# EasyEDA Pro project ProProject_IMUSensorNodes202312.epro, board 6_6_拼板20240123（不带编号） (continued)
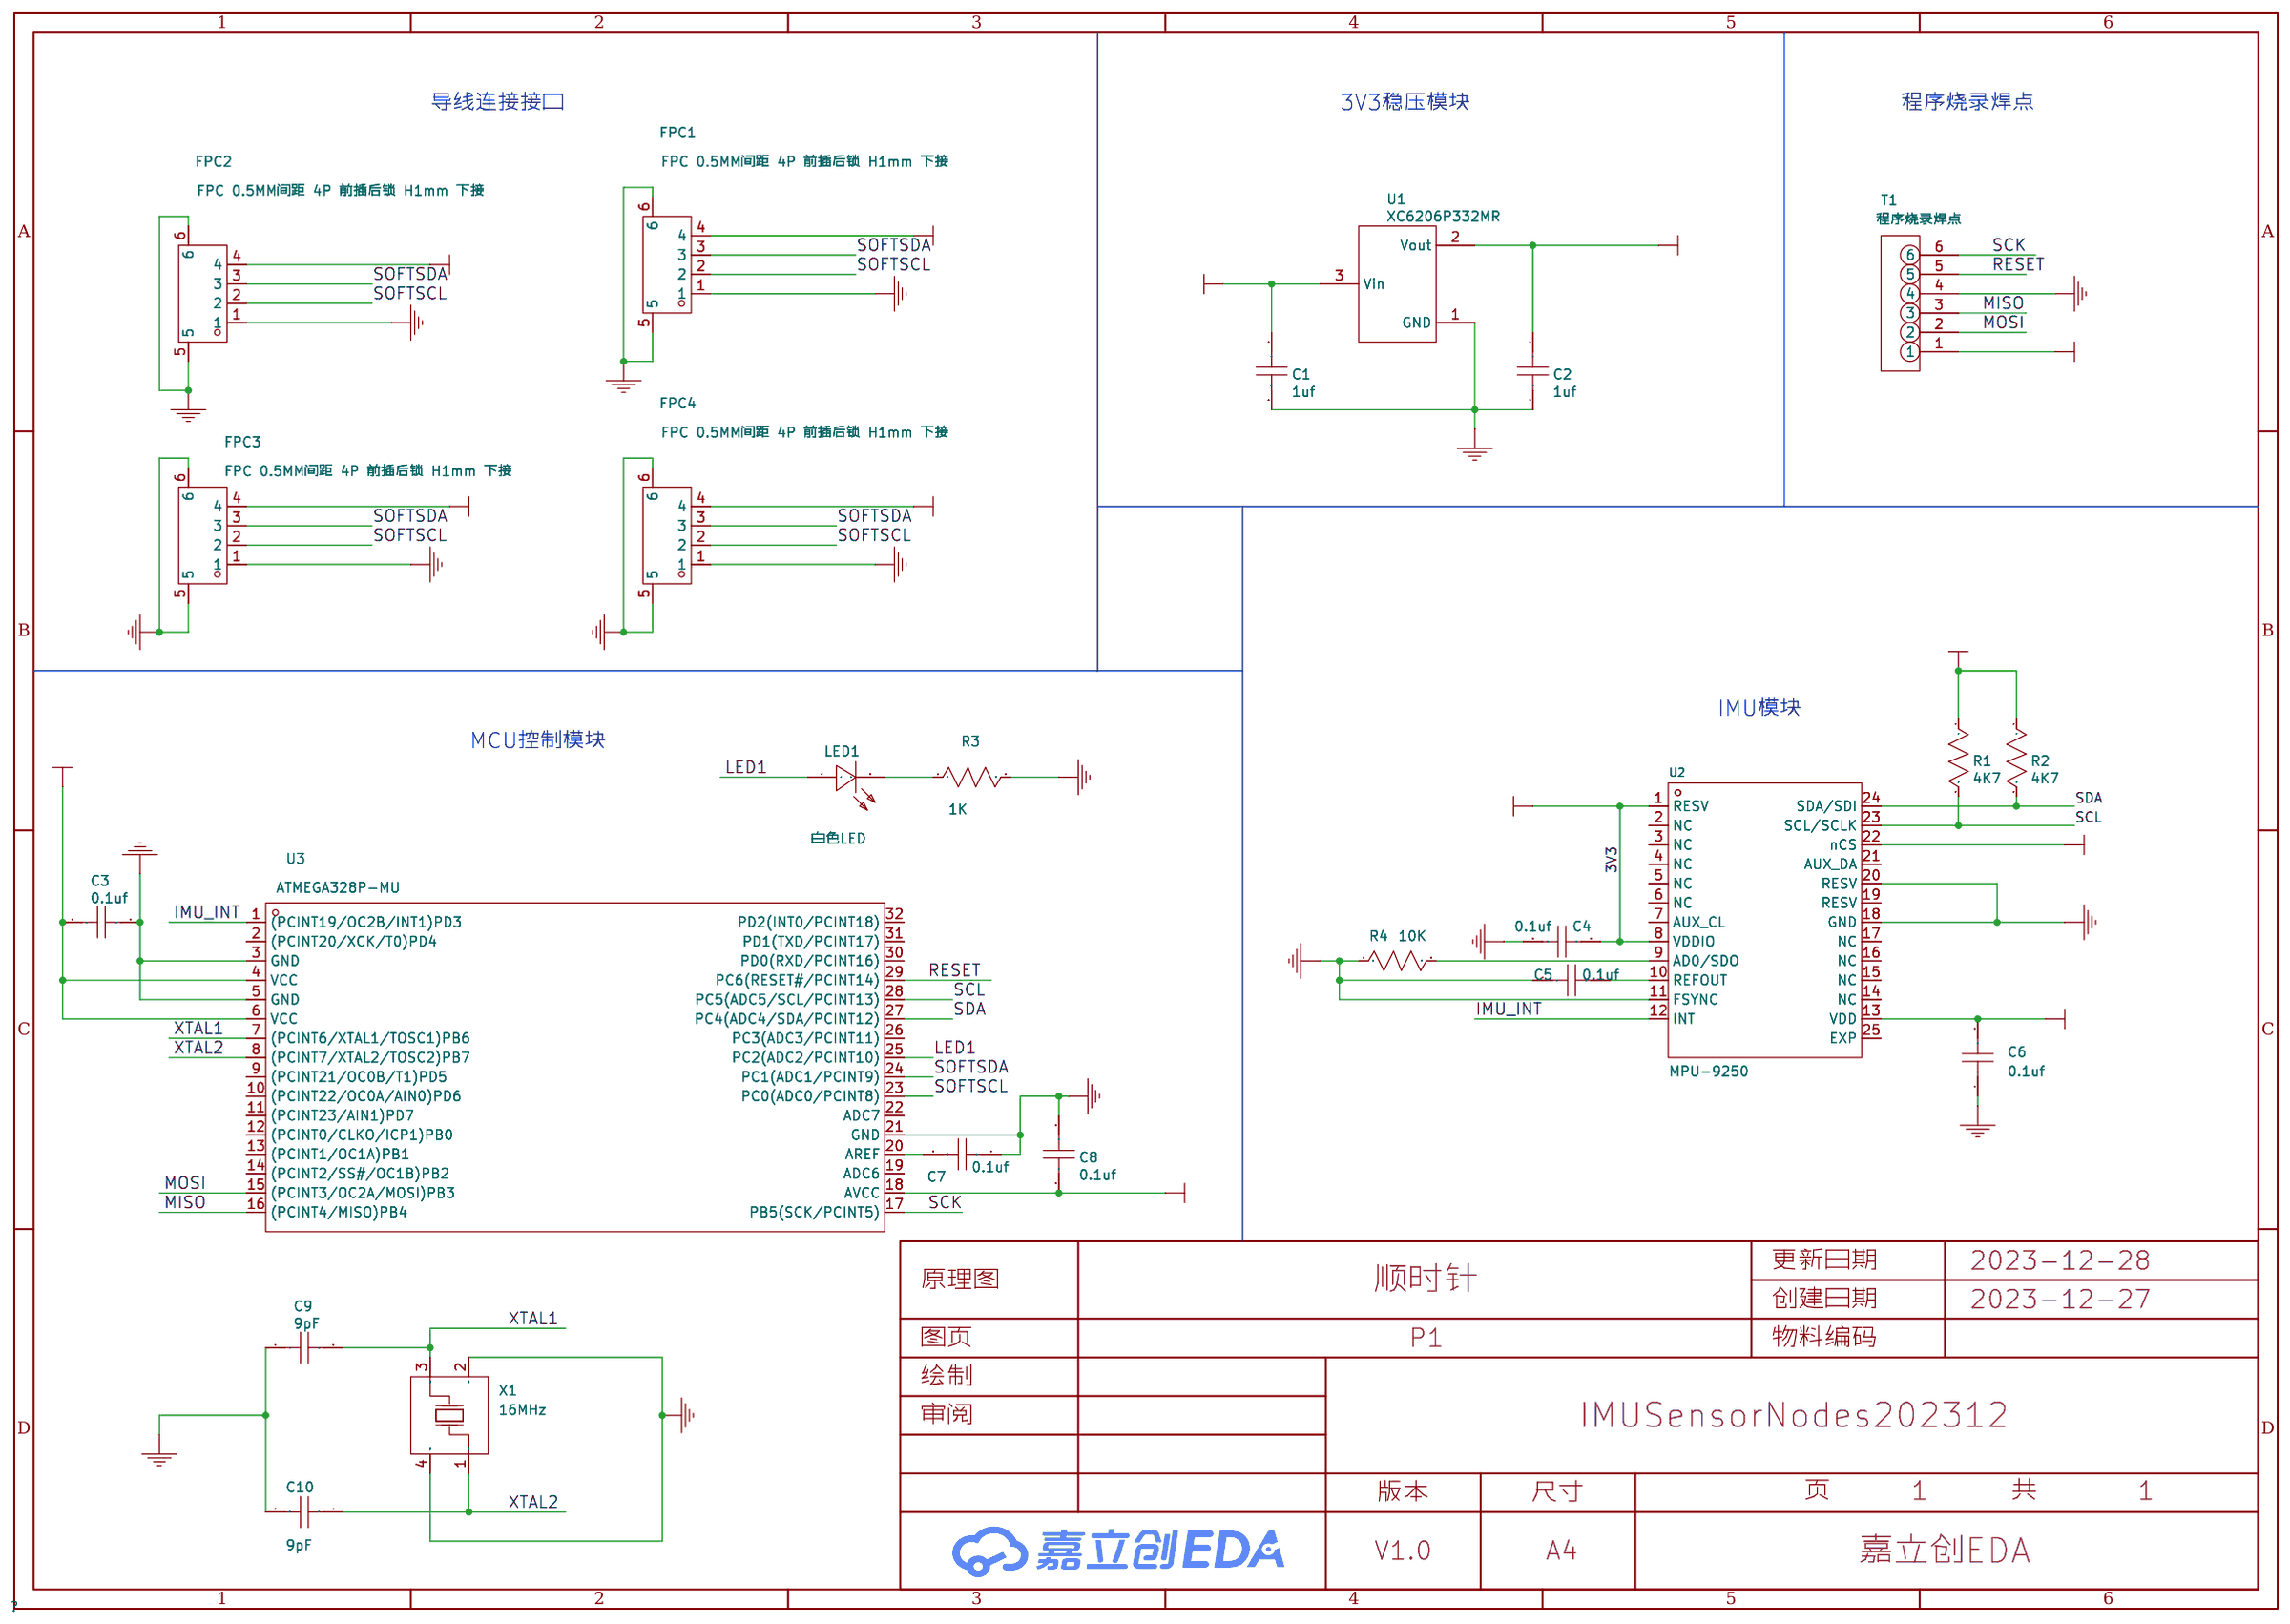
[diagram p0: schematic sheet]
## Copper pours and planes (outline as drawn; the poured copper is in the pictures) (continued)
5V on Top Layer: 32.44,75.46 34.19,75.46 34.19,73.67 32.44,73.67
5V on Top Layer: 5.13,34.31 6.88,34.31 6.88,32.52 5.13,32.52
5V on Top Layer: 73.58,6.76 75.09,6.76 75.09,5.24 73.58,5.24
5V on Top Layer: 32.44,48.02 34.19,48.02 34.19,46.24 32.44,46.24
5V on Top Layer: 73.58,34.19 75.09,34.19 75.09,32.67 73.58,32.67
5V on Top Layer: 59.74,61.74 61.49,61.74 61.49,59.95 59.74,59.95
5V on Top Layer: 59.74,34.31 61.49,34.31 61.49,32.52 59.74,32.52
5V on Top Layer: 5.13,6.88 6.88,6.88 6.88,5.09 5.13,5.09
5V on Top Layer: 5.13,20.59 6.88,20.59 6.88,18.81 5.13,18.81
5V on Top Layer: 18.97,20.48 20.48,20.48 20.48,18.95 18.97,18.95
5V on Top Layer: 46.27,6.76 47.78,6.76 47.78,5.24 46.27,5.24
GND on Top Layer: 30.06,73.87 32.04,73.87 32.04,71.4 30.06,71.4
GND on Top Layer: 40.92,80.67 52.99,80.67 52.99,68.61 40.92,68.61
GND on Top Layer: 13.62,80.67 25.69,80.67 25.69,68.61 13.62,68.61
GND on Top Layer: 2.75,32.72 4.73,32.72 4.73,30.25 2.75,30.25
GND on Top Layer: 68.23,53.24 80.29,53.24 80.29,41.18 68.23,41.18
GND on Top Layer: 40.92,39.53 52.99,39.53 52.99,27.46 40.92,27.46
GND on Top Layer: 27.21,39.53 39.4,39.53 39.4,27.33 27.21,27.33
GND on Top Layer: 40.92,53.24 52.99,53.24 52.99,41.18 40.92,41.18
GND on Top Layer: 27.21,25.81 39.4,25.81 39.4,13.62 27.21,13.62
GND on Top Layer: 13.62,53.24 25.69,53.24 25.69,41.18 13.62,41.18
GND on Top Layer: 13.62,39.53 25.69,39.53 25.69,27.46 13.62,27.46
GND on Top Layer: 30.06,32.72 32.04,32.72 32.04,30.25 30.06,30.25
GND on Top Layer: -0.1,12.09 12.1,12.09 12.1,-0.1 -0.1,-0.1
GND on Top Layer: 54.51,53.24 66.71,53.24 66.71,41.05 54.51,41.05
GND on Top Layer: 57.36,19 59.34,19 59.34,16.53 57.36,16.53
GND on Top Layer: 57.36,5.29 59.34,5.29 59.34,2.82 57.36,2.82
GND on Top Layer: 40.92,25.81 52.99,25.81 52.99,13.75 40.92,13.75
GND on Top Layer: -0.1,80.67 12.1,80.67 12.1,68.48 -0.1,68.48
GND on Top Layer: 68.23,39.53 80.29,39.53 80.29,27.46 68.23,27.46
GND on Top Layer: 68.23,25.81 80.29,25.81 80.29,13.75 68.23,13.75
GND on Top Layer: -0.1,39.53 12.1,39.53 12.1,27.33 -0.1,27.33
GND on Top Layer: 54.51,66.96 66.71,66.96 66.71,54.77 54.51,54.77
GND on Top Layer: 30.06,46.44 32.04,46.44 32.04,43.97 30.06,43.97
GND on Top Layer: 54.51,80.67 66.71,80.67 66.71,68.48 54.51,68.48
GND on Top Layer: 68.23,66.96 80.29,66.96 80.29,54.89 68.23,54.89
GND on Top Layer: 2.75,46.44 4.73,46.44 4.73,43.97 2.75,43.97
GND on Top Layer: 57.36,32.72 59.34,32.72 59.34,30.25 57.36,30.25
GND on Top Layer: -0.1,25.81 12.1,25.81 12.1,13.62 -0.1,13.62
GND on Top Layer: 68.23,12.09 80.29,12.09 80.29,0.03 68.23,0.03
GND on Top Layer: 57.36,46.44 59.34,46.44 59.34,43.97 57.36,43.97
GND on Top Layer: 2.75,73.87 4.73,73.87 4.73,71.4 2.75,71.4
GND on Top Layer: 40.92,12.09 52.99,12.09 52.99,0.03 40.92,0.03
GND on Top Layer: 2.75,19 4.73,19 4.73,16.53 2.75,16.53
GND on Top Layer: 54.51,25.81 66.71,25.81 66.71,13.62 54.51,13.62
GND on Top Layer: 13.62,12.09 25.69,12.09 25.69,0.03 13.62,0.03
GND on Top Layer: 68.23,80.67 80.29,80.67 80.29,68.61 68.23,68.61
GND on Top Layer: 30.06,60.15 32.04,60.15 32.04,57.68 30.06,57.68
GND on Top Layer: 27.21,80.67 39.4,80.67 39.4,68.48 27.21,68.48
GND on Top Layer: 54.51,12.09 66.71,12.09 66.71,-0.1 54.51,-0.1
GND on Top Layer: -0.1,66.96 12.1,66.96 12.1,54.77 -0.1,54.77
GND on Top Layer: 30.06,19 32.04,19 32.04,16.53 30.06,16.53
GND on Top Layer: 13.62,25.81 25.69,25.81 25.69,13.75 13.62,13.75
GND on Top Layer: 30.06,5.29 32.04,5.29 32.04,2.82 30.06,2.82
GND on Top Layer: 57.36,60.15 59.34,60.15 59.34,57.68 57.36,57.68
GND on Top Layer: 2.75,5.29 4.73,5.29 4.73,2.82 2.75,2.82
GND on Top Layer: -0.1,53.24 12.1,53.24 12.1,41.05 -0.1,41.05
GND on Top Layer: 54.51,39.53 66.71,39.53 66.71,27.33 54.51,27.33
GND on Top Layer: 13.62,66.96 25.69,66.96 25.69,54.89 13.62,54.89
GND on Top Layer: 27.21,53.24 39.4,53.24 39.4,41.05 27.21,41.05
GND on Top Layer: 27.21,66.96 39.4,66.96 39.4,54.77 27.21,54.77
GND on Top Layer: 27.21,12.09 39.4,12.09 39.4,-0.1 27.21,-0.1
GND on Top Layer: 2.75,60.15 4.73,60.15 4.73,57.68 2.75,57.68
GND on Top Layer: 40.92,66.96 52.99,66.96 52.99,54.89 40.92,54.89
GND on Top Layer: 57.36,73.87 59.34,73.87 59.34,71.4 57.36,71.4
GND on Bottom Layer: 13.62,80.67 25.69,80.67 25.69,68.61 13.62,68.61
GND on Bottom Layer: 13.62,66.96 25.69,66.96 25.69,54.89 13.62,54.89
GND on Bottom Layer: 54.51,12.09 66.71,12.09 66.71,-0.1 54.51,-0.1
GND on Bottom Layer: 40.92,39.53 52.99,39.53 52.99,27.46 40.92,27.46
GND on Bottom Layer: 13.62,12.09 25.69,12.09 25.69,0.03 13.62,0.03
GND on Bottom Layer: 27.21,66.96 39.4,66.96 39.4,54.77 27.21,54.77
GND on Bottom Layer: 40.92,25.81 52.99,25.81 52.99,13.75 40.92,13.75
GND on Bottom Layer: 27.21,25.81 39.4,25.81 39.4,13.62 27.21,13.62
GND on Bottom Layer: -0.1,80.67 12.1,80.67 12.1,68.48 -0.1,68.48
GND on Bottom Layer: 68.23,25.81 80.29,25.81 80.29,13.75 68.23,13.75
GND on Bottom Layer: 68.23,39.53 80.29,39.53 80.29,27.46 68.23,27.46
GND on Bottom Layer: 27.21,80.67 39.4,80.67 39.4,68.48 27.21,68.48
GND on Bottom Layer: 40.92,12.09 52.99,12.09 52.99,0.03 40.92,0.03
GND on Bottom Layer: 27.21,39.53 39.4,39.53 39.4,27.33 27.21,27.33
GND on Bottom Layer: 40.92,53.24 52.99,53.24 52.99,41.18 40.92,41.18
GND on Bottom Layer: 68.23,53.24 80.29,53.24 80.29,41.18 68.23,41.18
GND on Bottom Layer: 54.51,53.24 66.71,53.24 66.71,41.05 54.51,41.05
GND on Bottom Layer: -0.1,53.24 12.1,53.24 12.1,41.05 -0.1,41.05
GND on Bottom Layer: 54.51,66.96 66.71,66.96 66.71,54.77 54.51,54.77
GND on Bottom Layer: 54.51,80.67 66.71,80.67 66.71,68.48 54.51,68.48
GND on Bottom Layer: 68.23,12.09 80.29,12.09 80.29,0.03 68.23,0.03
GND on Bottom Layer: 54.51,39.53 66.71,39.53 66.71,27.33 54.51,27.33
GND on Bottom Layer: -0.1,12.09 12.1,12.09 12.1,-0.1 -0.1,-0.1
GND on Bottom Layer: -0.1,25.81 12.1,25.81 12.1,13.62 -0.1,13.62
GND on Bottom Layer: 13.62,53.24 25.69,53.24 25.69,41.18 13.62,41.18
GND on Bottom Layer: 13.62,25.81 25.69,25.81 25.69,13.75 13.62,13.75
GND on Bottom Layer: 68.23,66.96 80.29,66.96 80.29,54.89 68.23,54.89
GND on Bottom Layer: 54.51,25.81 66.71,25.81 66.71,13.62 54.51,13.62
GND on Bottom Layer: -0.1,66.96 12.1,66.96 12.1,54.77 -0.1,54.77
GND on Bottom Layer: 68.23,80.67 80.29,80.67 80.29,68.61 68.23,68.61
GND on Bottom Layer: 27.21,53.24 39.4,53.24 39.4,41.05 27.21,41.05
GND on Bottom Layer: 40.92,66.96 52.99,66.96 52.99,54.89 40.92,54.89
GND on Bottom Layer: 13.62,39.53 25.69,39.53 25.69,27.46 13.62,27.46
GND on Bottom Layer: 27.21,12.09 39.4,12.09 39.4,-0.1 27.21,-0.1
GND on Bottom Layer: -0.1,39.53 12.1,39.53 12.1,27.33 -0.1,27.33
GND on Bottom Layer: 40.92,80.67 52.99,80.67 52.99,68.61 40.92,68.61

Small or netless copper shapes (teardrops, artwork), in the pictures only: 36 on Top Layer

## Text on the board
Top Silkscreen Layer: X | Y
